# EasyEDA Pro project balance_car.eprj, board PCB3
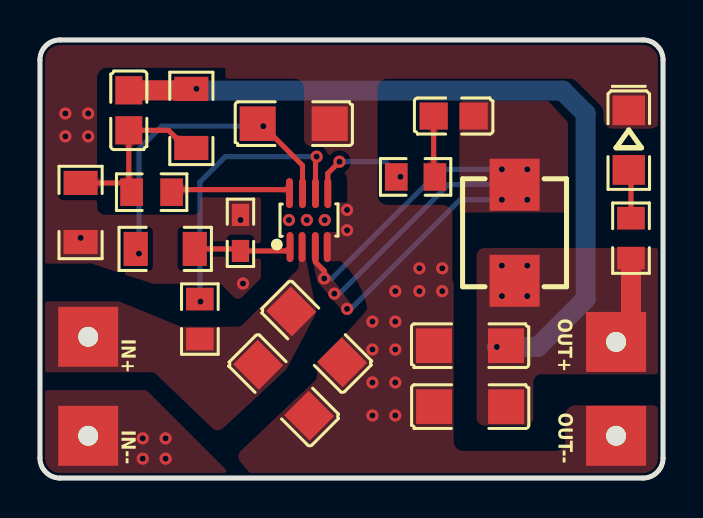
[diagram p6: board, top side]
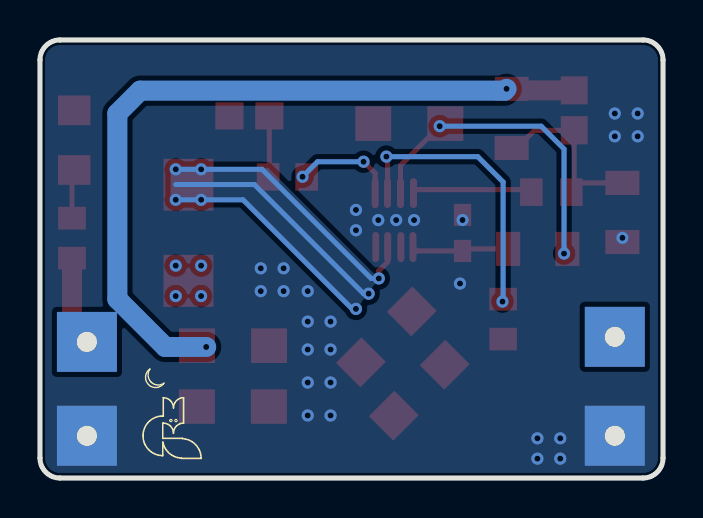
[diagram p7: board, bottom side, seen from below]

Outline 31.18 x 21.92 mm; copper layers: Top Layer, Bottom Layer. Coordinates in mm from the lower left corner of the outline.
Outline path: 0,20.92 0,1 arc(0.29,0.29) 1,0 30.18,0 arc(30.89,0.29) 31.18,1 31.18,20.92 arc(30.89,21.63) 30.18,21.92 1,21.92 arc(0.29,21.63) 0,20.92
Stack: Top Layer 0.035mm / Dielectric1 1.51mm FR4 er 4.5 / Bottom Layer 0.035mm

## Design rules (mm)
template: 自定义配置
spacing copperThickness1oz (default): track to track 0.102, other pairs 0 to 0.3
spacing copperThickness2oz: track to track 0.203, other pairs 0.152 to 0.3
track width copperThickness1oz (default): min 0.127, default 0.254, max 2.54
track width power: min 0.4, default 2, max 3
differential pair differentialPair (default): width min 0.127, default 0.254, max 2.54; gap min 0.152, default 0.152
via viaSize (default): diameter min 0.5, default 0.61, max 10; hole min 0.3, default 0.305, max 6.3
net GND uses power
net VIN uses power
net VOUT uses power
pour e484 uses copperRegion

## Placement (name value [footprint] x y rotation side)
C2  100nF  [C1206]  12.7 17.73 0 top
C4  100nF  [C0805]  20.7 18.12 180 top
C5  15pF  [C0805]  4.45 18.4 90 top
L2  4.7uH  [IND-SMD_L5.4-W5.2_FXL0530]  23.75 12.27 90 top
LED2  XL-3216SURC  [LED1206-R-RD_RED]  29.46 16.91 270 top
NOREF  -  [Pad_e20]  2.41 2.11 180 top
NOREF#2  -  [Pad_e27]  28.83 6.81 180 top
NOREF#3  -  [Pad_e25]  2.41 7.07 180 top
NOREF#4  -  [Pad_e26]  28.83 2.11 180 top
R1  100kΩ  [R1206]  6.27 11.47 0 top
R2  11.3kΩ  [R0603]  10.03 12.27 270 top
R3  10Ω  [R0805_NEW]  18.8 15.07 0 top
R4  33kΩ  [R0805]  5.59 14.31 180 top
R5  40.2kΩ  [R1206]  7.58 18 270 top
R6  13kΩ  [R1206]  2.03 13.29 90 top
R8  20kΩ  [R0805]  8 7.96 90 top
R9  2.2kΩ  [R0805]  29.58 12 90 top
U1  MP1495SGJ-Z  [SOT-23-8_L2.9-W1.6-P0.65-LS2.8-BR]  13.46 12.91 270 top
U3  22uF  [C1206]  13.84 7.07 135 top
U5  22uF  [C1206]  21.53 3.57 0 top
U7  N/A  [C1206]  12.19 4.4 315 top
U8  22uF  [C1206]  21.52 6.62 0 top

## Footprints (pads in the part's own frame, mm; a bottom-side part is the same pattern mirrored in y, then rotated)
C0805
  rect 1.41x1.35 smd: 1(-1,0) 2(1,0)
C1206
  rect 1.8x1.728 smd: 1(-1.806,0) 2(1.798,0)
IND-SMD_L5.4-W5.2_FXL0530
  rect 2.6x2.5 smd: 1(-2.405,0) 2(2.405,0)
LED1206-R-RD_RED
  rect 1.485x1.62 smd: 1(1.492,0) 2(-1.492,0)
Pad_e20
  rect 3x3 hole 1: 1(0,0)
Pad_e25
  rect 3x3 hole 1: 1(0,0)
Pad_e26
  rect 3x3 hole 1: 1(0,0)
Pad_e27
  rect 3x3 hole 1: 1(0,0)
R0603
  rect 1.106x0.864 smd: 1(-0.89,0) 2(0.909,0)
R0805
  rect 1.133x1.377 smd: 1(-1,0) 2(1,0)
R0805_NEW
  rect 1.133x1.377 smd: 1(-0.966,0) 2(0.966,0)
R1206
  rect 1.208x1.701 smd: 1(-1.479,0) 2(1.479,0)
SOT-23-8_L2.9-W1.6-P0.65-LS2.8-BR
  oval 1.5x0.35 smd: 1(1.35,-0.948) 2(1.35,-0.346) 3(1.35,0.318) 4(1.35,0.913) 5(-1.35,0.941) 6(-1.35,0.325) 7(-1.35,-0.325) 8(-1.35,-0.975)

## Nets
GND: C2.2 LED2.2 NOREF.1 NOREF#4.1 R2.1 R6.1 U1.4 U3.1 U5.1 U7.2 U8.1
VIN: NOREF#3.1 R8.1 U1.2 U3.2 U7.1
AAM_C: R1.2 R2.2 U1.1
VOUT: C5.2 L2.1 NOREF#2.1 R5.1 R9.1 U5.2 U8.2
$1N747: C2.1 R1.1 U1.7
$1N910: R8.2 U1.6
$1N1047: C4.1 L2.2 U1.3
$1N1266: C4.2 R3.2
$1N1268: R3.1 U1.5
$1N1529: R4.1 U1.8
$1N1683: C5.1 R4.2 R5.2 R6.2
$1N2615: LED2.1 R9.2

## Via types
v1: diameter 0.61, hole 0.305, Top Layer to Bottom Layer, 48 vias

## Routing (per net, layer and track width the routed paths; a pad name or vN(x,y) marks a point on that pad's centre or on a via; arc(x,y) is an arc through that point)
GND:
  vias: v1(1.27,18.24) v1(1.27,17.1) v1(2.03,12.02) v1(2.41,18.24) v1(2.41,17.1) v1(5.14,1.99) v1(5.14,0.97) v1(6.29,1.99) v1(6.29,0.97) v1(10.03,12.91) v1(10.16,9.73) v1(12.46,12.91) v1(13.35,12.91) v1(14.25,12.91) v1(15.37,13.42) v1(15.37,12.4) v1(16.64,7.83) v1(16.64,6.43) v1(16.64,4.78) v1(16.64,3.13) v1(17.78,9.35) v1(17.78,7.83) v1(17.78,6.43) v1(17.78,4.78) v1(17.78,3.13) v1(18.99,10.5) v1(18.99,9.35) v1(20.13,10.5) v1(20.13,9.35)
AAM_C: length 4.9
  Top Layer w0.254: R1.2 9.93,11.47 R2.2 12.32,11.36 U1.1
VOUT: length 42.6
  Top Layer w1: R9.1 29.58,7.56 NOREF#2.1 ; C5.2 7.75,19.4 v1(7.83,19.48)
  Bottom Layer w1: v1(22.86,6.56) 24.91,6.56 27.31,8.95 27.31,18.24 26.16,19.39 7.92,19.39 v1(7.83,19.48)
  vias: v1(23.11,10.63) v1(23.11,9.11) v1(24.38,10.63) v1(24.38,9.11)
$1N747: length 16.1
  Top Layer w0.254: v1(11.18,17.61) 13.14,15.65 U1.7
  Bottom Layer w0.254: v1(4.95,11.23) 4.95,16.46 6.1,17.61 v1(11.18,17.61)
$1N910: length 14.2
  Top Layer w0.254: U1.6 13.79,16.03 v1(13.84,16.08)
  Bottom Layer w0.254: v1(8.03,8.83) 8,8.86 8,14.81 9.27,16.08 v1(13.84,16.08)
$1N1047: length 37.4
  Top Layer w0.254: 13.78,11.56 13.78,10.81 14.22,10.37 v1(14.22,9.99)
  Bottom Layer w0.254: v1(24.38,15.45) v1(23.11,15.45) 20.07,15.45 14.61,9.99 v1(14.22,9.99) ; v1(15.37,8.46) 15.56,8.46 21.02,13.92 v1(23.11,13.92) v1(24.38,13.92) ; v1(14.73,9.23) 14.99,9.23 20.45,14.69 24.38,14.69
$1N1266: length 3.1
  Top Layer w0.254: C4.2 19.7,15.26 19.51,15.07
$1N1268: length 5.2
  Top Layer w0.254: U1.5 14.4,15.25 v1(14.99,15.83)
  Bottom Layer w0.254: v1(14.99,15.83) 17.29,15.83 v1(18.04,15.08)
$1N1529: length 6.5
  Top Layer w0.254: U1.8 12.49,14.39 12.45,14.43 6.72,14.43 6.33,14.81
$1N1683: length 8.8
  Top Layer w0.254: 1.78,14.77 4.45,14.77 C5.1 6.43,17.4 7.31,16.52 R5.2
$1N2615: length 2.5
  Top Layer w0.254: LED2.1 29.58,15.31 R9.2

## Copper pours and planes (outline as drawn; the poured copper is in the pictures)
GND on Top Layer: 14.16,0.1 14.06,0.08 10.83,0.08 10.67,0.12 10.53,0.22 10.02,0.81 9.93,1.09 10.05,1.36 13.74,4.86 13.83,5 13.86,5.16 13.85,5.58 13.87,5.74 13.96,5.87 15.14,7.09 15.78,7.76 16.38,8.46 15.91,9.77 15.04,10.86 14.59,10.85 14.3,10.96 14.18,11.25 14.18,12.31 14.94,12.31 14.94,13.8 15.37,13.8 15.37,14.91 15.33,15.1 15.22,15.26 13.99,16.49 14.04,16.54 14.04,16.59 13.61,16.59 13.33,16.71 13.21,16.99 13.21,19.49 13.06,19.84 12.71,19.99 9.27,19.99 9.27,20.53 3.36,20.53 3,20.38 2.86,20.03 2.86,13.58 2.97,13.3 3.26,13.18 7.7,13.18 7.91,13.27 8,13.48 8,13.88 8.09,14.09 8.3,14.18 10.76,14.18 10.97,14.09 11.06,13.88 11.06,10.12 11.03,10.01 10.97,9.91 10.12,9.06 10.02,8.99 9.91,8.97 9.79,8.99 9.69,9.06 9.04,9.71 9.04,9.72 5.7,9.72 5.66,9.72 5.61,9.73 2.62,10.72 2.58,10.74 2.54,10.77 2.45,10.74 2.36,10.73 0.12,10.73 -0.02,10.98 0.13,11.23 0.13,21.78 0.43,22.06 0.83,22.18 30.06,22.18 30.71,21.87 31.18,21.33 31.18,19.94 31.3,19.79 31.18,19.63 31.18,19.55 31.09,19.36 31.24,19.21 31.24,17.91 30.79,17.56 30.23,17.48 28.69,17.48 28.34,17.63 28.19,17.98 28.19,18.29 28.16,18.48 28.05,18.64 26.85,19.84 26.69,19.95 26.5,19.99 17.39,19.99 17.04,19.84 16.89,19.49 16.89,14.17 17.04,13.82 17.39,13.67 20.14,13.67 20.49,13.52 20.64,13.17 20.64,9.88 20.7,9.88 20.7,1.85 20.85,1.5 21.2,1.35 25.79,1.35 26.14,1.5 26.29,1.85 26.29,3.14 26.44,3.49 26.79,3.64 30.62,3.64 30.97,3.5 31.12,3.14 31.12,0.81 31.03,0.53 30.89,0.29 30.57,0.15 30.23,0.08 14.47,0.08 14.35,0.11 14.23,0.16
GND on Top Layer: 0.13,4.4 5.33,4.4 9.78,-0.05 0.38,-0.05 0.13,-0.3
GND on Bottom Layer: 0.25,21.67 31.12,21.67 31.12,0.21 0.25,0.21
VIN on Top Layer: 13.81,8.43 13.82,8.3 13.77,8.17 12.35,5.48 12.31,5.42 12.27,5.37 9.17,2.5 8.89,2.39 8.62,2.5 5.83,5.18 5.7,5.26 5.55,5.29 0.18,5.29 -0.06,5.42 -0.13,5.69 -0.13,8.44 -0.09,8.71 0.14,8.84 3.87,8.84 3.95,8.84 4.02,8.81 6.98,7.6 7.05,7.58 7.13,7.57 9.87,7.57 10.02,7.61 10.15,7.69 12.32,9.86 12.32,9.87 12.83,10.38 12.92,10.51 12.95,10.66 12.95,11.18 13.27,11.19
VOUT on Top Layer: 22.24,11.51 21.96,11.39 21.84,11.11 21.84,3.02 21.96,2.74 22.24,2.62 24.29,2.62 24.57,2.74 24.69,3.02 24.69,4.79 24.81,5.08 25.09,5.19 30.78,5.19 31.09,5.3 31.24,5.59 31.24,11.11 31.11,11.4 30.82,11.51
$1N1047 on Top Layer: 20.99,13.49 21.04,13.35 21.19,13.29 26.22,13.29 26.36,13.35 26.42,13.49 26.42,17.72 26.4,17.8 26.36,17.86 25.5,18.8 25.43,18.85 25.35,18.87 21.19,18.87 21.04,18.81 20.99,18.67
$1N1047 on Top Layer: 13.6,11 13.89,9.81 15.34,8.13 15.74,8.48 13.91,10.97 13.89,11
$1N1047 on Bottom Layer: 14.22,10.11 14.22,9.99 15.43,8.34 21.02,13.92 24.64,13.92 24.64,15.45 19.94,15.45 19.81,15.58 14.35,10.11

Small or netless copper shapes (teardrops, artwork), in the pictures only: 8 on Top Layer, 3 on Bottom Layer

## Text on the board
Top Silkscreen Layer: IN-- | OUT+ | OUT-- | IN+
